# EasyEDA Pro project 3SE_24_Power_Rune.eprj, board 深大PCB参考 (continued)
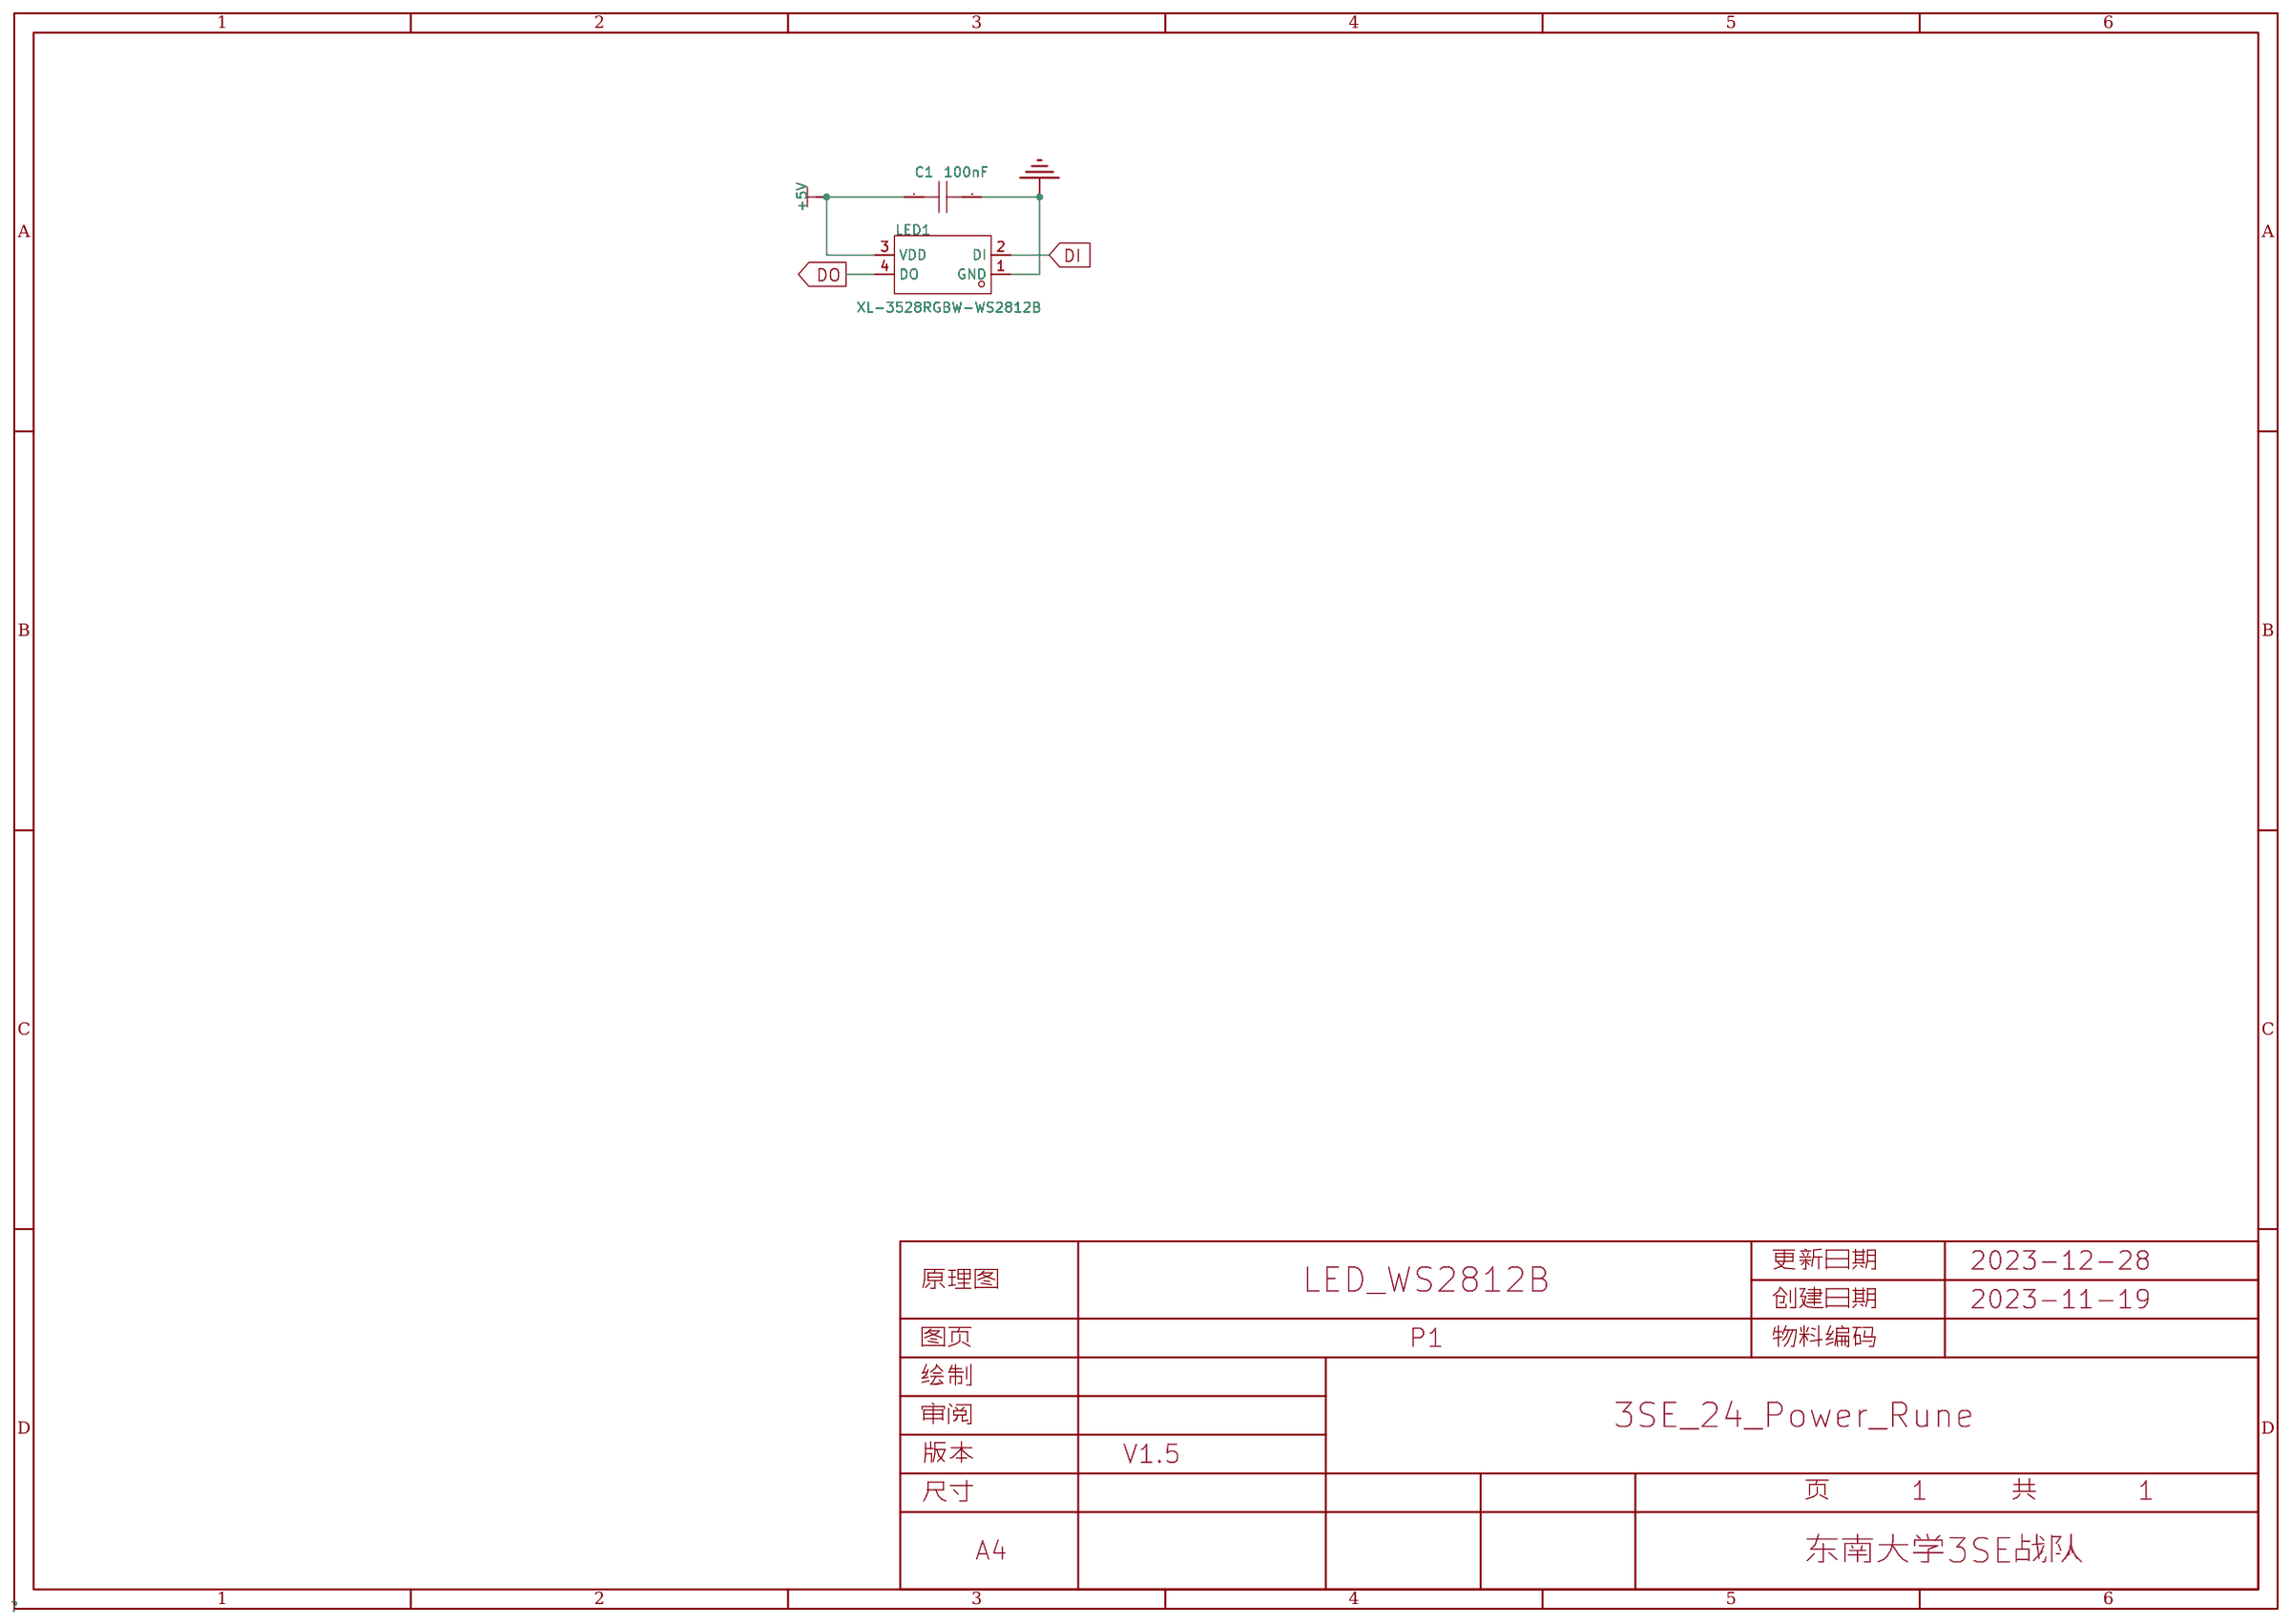
[diagram p0: schematic sheet]
## Placement (name value [footprint] x y rotation side) (continued)
C428  -  [C_0603]  220.09 168.4 54 top
C429  -  [C_0603]  203.58 153.8 105 top
C430  -  [C_0603]  187.32 150.11 6 top
C431  -  [C_0603]  171.7 152.4 342 top
C432  -  [C_0603]  159 158.62 318 top
C433  -  [C_0603]  146.56 172.59 15 top
C434  -  [C_0603]  142.11 193.68 270 top
C435  -  [C_0603]  144.27 206.88 246 top
C436  -  [C_0603]  150.37 217.55 222 top
C437  -  [C_0603]  165.99 229.74 285 top
C438  -  [C_0603]  190.37 234.32 174 top
C439  -  [C_0603]  206.78 228.14 150 top
C440  -  [C_0603]  222.5 212.09 195 top
C441  -  [C_0603]  210.44 203.71 195 top
C442  -  [C_0603]  207.14 177.93 45 top
C443  -  [C_0603]  191.77 178.82 90 top
C444  -  [C_0603]  170.69 169.29 315 top
C445  -  [C_0603]  160.02 182.25 15 top
C446  -  [C_0603]  167.13 198.25 45 top
C447  -  [C_0603]  173.74 218.44 285 top
C448  -  [C_0603]  197.87 217.42 135 top
C449  -  [C_0603]  177.93 205.74 270 top
C450  -  [C_0603]  196.72 188.72 180 top
C451  -  [C_0603]  195.07 166.37 105 top
C452  -  [C_0603]  172.08 195.83 0 top
D1  -  [LED-SMD_4P-L5.0-W5.0-TL_WS2812B-B]  22.35 253.11 160 top
D2  -  [LED-SMD_4P-L5.0-W5.0-TL_WS2812B-B]  33.49 249.33 160 top
D3  -  [LED-SMD_4P-L5.0-W5.0-TL_WS2812B-B]  24.77 265.3 160 top
D4  -  [LED-SMD_4P-L5.0-W5.0-TL_WS2812B-B]  37.46 260.99 160 top
D5  -  [LED-SMD_4P-L5.0-W5.0-TL_WS2812B-B]  27.34 278.74 160 top
D6  -  [LED-SMD_4P-L5.0-W5.0-TL_WS2812B-B]  40.77 273.05 160 top
D7  -  [LED-SMD_4P-L5.0-W5.0-TL_WS2812B-B]  30.1 291.34 160 top
D8  -  [LED-SMD_4P-L5.0-W5.0-TL_WS2812B-B]  44.58 286 160 top
D9  -  [LED-SMD_4P-L5.0-W5.0-TL_WS2812B-B]  33.46 305.61 160 top
D10  -  [LED-SMD_4P-L5.0-W5.0-TL_WS2812B-B]  46.61 300.36 160 top
D11  -  [LED-SMD_4P-L5.0-W5.0-TL_WS2812B-B#3]  37.03 320.47 140 top
D12  -  [LED-SMD_4P-L5.0-W5.0-TL_WS2812B-B#3]  49.02 311.79 140 top
D13  -  [LED-SMD_4P-L5.0-W5.0-TL_WS2812B-B#2]  39.19 342.54 130 top
D14  -  [LED-SMD_4P-L5.0-W5.0-TL_WS2812B-B#2]  45.85 334.52 130 top
D15  -  [LED-SMD_4P-L5.0-W5.0-TL_WS2812B-B#2]  52.2 325.12 130 top
D16  -  [LED-SMD_4P-L5.0-W5.0-TL_WS2812B-B]  56.01 349.5 110 top
D17  -  [LED-SMD_4P-L5.0-W5.0-TL_WS2812B-B]  61.09 338.46 110 top
D18  -  [LED-SMD_4P-L5.0-W5.0-TL_WS2812B-B]  65.41 327.28 110 top
D19  -  [LED-SMD_4P-L5.0-W5.0-TL_WS2812B-B]  68.96 354.33 110 top
D20  -  [LED-SMD_4P-L5.0-W5.0-TL_WS2812B-B]  73.66 342.9 110 top
D21  -  [LED-SMD_4P-L5.0-W5.0-TL_WS2812B-B]  77.34 331.98 110 top
D22  -  [LED-SMD_4P-L5.0-W5.0-TL_WS2812B-B]  81.15 358.78 110 top
D23  -  [LED-SMD_4P-L5.0-W5.0-TL_WS2812B-B]  86.11 347.6 110 top
D24  -  [LED-SMD_4P-L5.0-W5.0-TL_WS2812B-B]  91.82 336.55 110 top
D25  -  [LED-SMD_4P-L5.0-W5.0-TL_WS2812B-B]  96.39 363.35 110 top
D26  -  [LED-SMD_4P-L5.0-W5.0-TL_WS2812B-B]  100.71 350.77 110 top
D27  -  [LED-SMD_4P-L5.0-W5.0-TL_WS2812B-B]  104.52 340.36 110 top
D28  -  [LED-SMD_4P-L5.0-W5.0-TL_WS2812B-B]  110.13 366.99 110 top
D29  -  [LED-SMD_4P-L5.0-W5.0-TL_WS2812B-B]  113.92 354.84 110 top
D30  -  [LED-SMD_4P-L5.0-W5.0-TL_WS2812B-B]  117.98 343.79 110 top
D31  -  [LED-SMD_4P-L5.0-W5.0-TL_WS2812B-B]  120.9 370.71 110 top
D32  -  [LED-SMD_4P-L5.0-W5.0-TL_WS2812B-B]  125.6 359.41 110 top
D33  -  [LED-SMD_4P-L5.0-W5.0-TL_WS2812B-B]  129.79 348.74 110 top
D34  -  [LED-SMD_4P-L5.0-W5.0-TL_WS2812B-B]  132.97 374.14 110 top
D35  -  [LED-SMD_4P-L5.0-W5.0-TL_WS2812B-B]  137.03 362.84 110 top
D36  -  [LED-SMD_4P-L5.0-W5.0-TL_WS2812B-B]  140.59 351.79 110 top
D37  -  [LED-SMD_4P-L5.0-W5.0-TL_WS2812B-B]  150.37 374.78 95 top
D38  -  [LED-SMD_4P-L5.0-W5.0-TL_WS2812B-B]  151.51 364.11 95 top
D39  -  [LED-SMD_4P-L5.0-W5.0-TL_WS2812B-B]  152.65 353.57 95 top
D40  -  [LED-SMD_4P-L5.0-W5.0-TL_WS2812B-B]  166.37 374.65 90 top
D41  -  [LED-SMD_4P-L5.0-W5.0-TL_WS2812B-B]  166.37 364.24 90 top
D42  -  [LED-SMD_4P-L5.0-W5.0-TL_WS2812B-B]  165.99 353.06 90 top
D43  -  [LED-SMD_4P-L5.0-W5.0-TL_WS2812B-B]  179.58 374.78 90 top
D44  -  [LED-SMD_4P-L5.0-W5.0-TL_WS2812B-B]  179.32 363.73 90 top
D45  -  [LED-SMD_4P-L5.0-W5.0-TL_WS2812B-B]  179.07 352.43 90 top
D46  -  [LED-SMD_4P-L5.0-W5.0-TL_WS2812B-B]  193.68 375.03 90 top
D47  -  [LED-SMD_4P-L5.0-W5.0-TL_WS2812B-B]  193.55 363.98 90 top
D48  -  [LED-SMD_4P-L5.0-W5.0-TL_WS2812B-B]  193.55 352.55 90 top
D49  -  [LED-SMD_4P-L5.0-W5.0-TL_WS2812B-B]  206.75 375.2 90 top
D50  -  [LED-SMD_4P-L5.0-W5.0-TL_WS2812B-B]  206.76 364.11 90 top
D51  -  [LED-SMD_4P-L5.0-W5.0-TL_WS2812B-B]  207.26 352.9 90 top
D52  -  [LED-SMD_4P-L5.0-W5.0-TL_WS2812B-B]  220.6 375.2 90 top
D53  -  [LED-SMD_4P-L5.0-W5.0-TL_WS2812B-B]  220.98 365.12 90 top
D54  -  [LED-SMD_4P-L5.0-W5.0-TL_WS2812B-B]  220.47 352.93 90 top
D55  -  [LED-SMD_4P-L5.0-W5.0-TL_WS2812B-B]  239.9 372.62 70 top
D56  -  [LED-SMD_4P-L5.0-W5.0-TL_WS2812B-B]  236.35 361.95 70 top
D57  -  [LED-SMD_4P-L5.0-W5.0-TL_WS2812B-B]  232.18 349.67 70 top
D58  -  [LED-SMD_4P-L5.0-W5.0-TL_WS2812B-B]  254.13 368.55 70 top
D59  -  [LED-SMD_4P-L5.0-W5.0-TL_WS2812B-B]  250.06 357.63 70 top
D60  -  [LED-SMD_4P-L5.0-W5.0-TL_WS2812B-B]  244.98 346.2 70 top
D61  -  [LED-SMD_4P-L5.0-W5.0-TL_WS2812B-B]  267.08 364.36 70 top
D62  -  [LED-SMD_4P-L5.0-W5.0-TL_WS2812B-B]  262.64 353.06 70 top
D63  -  [LED-SMD_4P-L5.0-W5.0-TL_WS2812B-B]  257.68 341.38 70 top
D64  -  [LED-SMD_4P-L5.0-W5.0-TL_WS2812B-B]  281.28 359.75 70 top
D65  -  [LED-SMD_4P-L5.0-W5.0-TL_WS2812B-B]  275.97 348.49 70 top
D66  -  [LED-SMD_4P-L5.0-W5.0-TL_WS2812B-B]  271.02 336.8 70 top
D67  -  [LED-SMD_4P-L5.0-W5.0-TL_WS2812B-B]  293.93 355.42 70 top
D68  -  [LED-SMD_4P-L5.0-W5.0-TL_WS2812B-B]  289.18 344.55 70 top
D69  -  [LED-SMD_4P-L5.0-W5.0-TL_WS2812B-B]  284.07 332.45 70 top
D70  -  [LED-SMD_4P-L5.0-W5.0-TL_WS2812B-B]  306.58 351.03 70 top
D71  -  [LED-SMD_4P-L5.0-W5.0-TL_WS2812B-B]  302.39 340.11 70 top
D72  -  [LED-SMD_4P-L5.0-W5.0-TL_WS2812B-B]  297.94 328.17 70 top
D73  -  [LED-SMD_4P-L5.0-W5.0-TL_WS2812B-B]  318.52 346.84 70 top
D74  -  [LED-SMD_4P-L5.0-W5.0-TL_WS2812B-B]  314.58 336.04 70 top
D75  -  [LED-SMD_4P-L5.0-W5.0-TL_WS2812B-B]  310.77 325.88 70 top
D76  -  [LED-SMD_4P-L5.0-W5.0-TL_WS2812B-B#3]  335.2 337.49 50 top
D77  -  [LED-SMD_4P-L5.0-W5.0-TL_WS2812B-B#3]  326.94 327.71 50 top
D78  -  [LED-SMD_4P-L5.0-W5.0-TL_WS2812B-B#3]  317.67 317.17 50 top
D79  -  [LED-SMD_4P-L5.0-W5.0-TL_WS2812B-B#2]  336.93 316.23 40 top
D80  -  [LED-SMD_4P-L5.0-W5.0-TL_WS2812B-B#2]  323.9 307 40 top
D81  -  [LED-SMD_4P-L5.0-W5.0-TL_WS2812B-B]  340.49 297.43 20 top
D82  -  [LED-SMD_4P-L5.0-W5.0-TL_WS2812B-B]  326.26 292.35 20 top
D83  -  [LED-SMD_4P-L5.0-W5.0-TL_WS2812B-B]  342.19 283.16 20 top
D84  -  [LED-SMD_4P-L5.0-W5.0-TL_WS2812B-B]  329.44 279.53 20 top
D85  -  [LED-SMD_4P-L5.0-W5.0-TL_WS2812B-B]  344.86 268.56 20 top
D86  -  [LED-SMD_4P-L5.0-W5.0-TL_WS2812B-B]  331.6 264.67 20 top
D87  -  [LED-SMD_4P-L5.0-W5.0-TL_WS2812B-B]  347.47 254.25 20 top
D88  -  [LED-SMD_4P-L5.0-W5.0-TL_WS2812B-B]  335.41 249.68 20 top
D89  -  [LED-SMD_4P-L5.0-W5.0-TL_WS2812B-B]  28.83 135.13 20 top
D90  -  [LED-SMD_4P-L5.0-W5.0-TL_WS2812B-B]  12.06 130.18 20 top
D91  -  [LED-SMD_4P-L5.0-W5.0-TL_WS2812B-B]  31.75 123.06 20 top
D92  -  [LED-SMD_4P-L5.0-W5.0-TL_WS2812B-B]  15.58 115.42 20 top
D93  -  [LED-SMD_4P-L5.0-W5.0-TL_WS2812B-B]  34.54 110.1 20 top
D94  -  [LED-SMD_4P-L5.0-W5.0-TL_WS2812B-B]  15.49 102.36 20 top
D95  -  [LED-SMD_4P-L5.0-W5.0-TL_WS2812B-B]  40.08 97.14 20 top
D96  -  [LED-SMD_4P-L5.0-W5.0-TL_WS2812B-B]  26.67 92.84 20 top
D97  -  [LED-SMD_4P-L5.0-W5.0-TL_WS2812B-B]  13.34 87.38 20 top
D98  -  [LED-SMD_4P-L5.0-W5.0-TL_WS2812B-B]  44.32 84.84 30 top
D99  -  [LED-SMD_4P-L5.0-W5.0-TL_WS2812B-B]  30.29 77.98 30 top
D100  -  [LED-SMD_4P-L5.0-W5.0-TL_WS2812B-B]  15.88 70.87 30 top
D101  -  [LED-SMD_4P-L5.0-W5.0-TL_WS2812B-B]  50.16 71.55 30 top
D102  -  [LED-SMD_4P-L5.0-W5.0-TL_WS2812B-B]  38.1 65.41 30 top
D103  -  [LED-SMD_4P-L5.0-W5.0-TL_WS2812B-B]  26.03 58.04 30 top
D104  -  [LED-SMD_4P-L5.0-W5.0-TL_WS2812B-B]  13.59 50.29 30 top
D105  -  [LED-SMD_4P-L5.0-W5.0-TL_WS2812B-B#2]  53.72 58.8 40 top
D106  -  [LED-SMD_4P-L5.0-W5.0-TL_WS2812B-B#2]  42.55 48.7 40 top
D107  -  [LED-SMD_4P-L5.0-W5.0-TL_WS2812B-B#2]  31.37 38.61 40 top
D108  -  [LED-SMD_4P-L5.0-W5.0-TL_WS2812B-B]  65.53 49.78 70 top
D109  -  [LED-SMD_4P-L5.0-W5.0-TL_WS2812B-B]  62.48 40.39 70 top
D110  -  [LED-SMD_4P-L5.0-W5.0-TL_WS2812B-B]  58.42 29.59 70 top
D111  -  [LED-SMD_4P-L5.0-W5.0-TL_WS2812B-B]  78.66 47.57 70 top
D112  -  [LED-SMD_4P-L5.0-W5.0-TL_WS2812B-B]  75.06 36.19 70 top
D113  -  [LED-SMD_4P-L5.0-W5.0-TL_WS2812B-B]  71.5 25.91 70 top
D114  -  [LED-SMD_4P-L5.0-W5.0-TL_WS2812B-B]  92.58 44.07 70 top
D115  -  [LED-SMD_4P-L5.0-W5.0-TL_WS2812B-B]  89.15 31.75 70 top
D116  -  [LED-SMD_4P-L5.0-W5.0-TL_WS2812B-B]  84.96 21.97 70 top
D117  -  [LED-SMD_4P-L5.0-W5.0-TL_WS2812B-B]  108.62 42.11 70 top
D118  -  [LED-SMD_4P-L5.0-W5.0-TL_WS2812B-B]  104.78 29.34 70 top
D119  -  [LED-SMD_4P-L5.0-W5.0-TL_WS2812B-B]  100.46 18.54 70 top
D120  -  [LED-SMD_4P-L5.0-W5.0-TL_WS2812B-B]  124.21 37.08 70 top
D121  -  [LED-SMD_4P-L5.0-W5.0-TL_WS2812B-B]  119.76 25.53 70 top
D122  -  [LED-SMD_4P-L5.0-W5.0-TL_WS2812B-B]  115.44 15.37 70 top
D123  -  [LED-SMD_4P-L5.0-W5.0-TL_WS2812B-B]  136.78 34.29 70 top
D124  -  [LED-SMD_4P-L5.0-W5.0-TL_WS2812B-B]  133.22 22.48 70 top
D125  -  [LED-SMD_4P-L5.0-W5.0-TL_WS2812B-B]  129.41 11.3 70 top
D126  -  [LED-SMD_4P-L5.0-W5.0-TL_WS2812B-B]  149.99 31.37 70 top
D127  -  [LED-SMD_4P-L5.0-W5.0-TL_WS2812B-B]  146.3 20.57 70 top
D128  -  [LED-SMD_4P-L5.0-W5.0-TL_WS2812B-B]  143.38 9.02 70 top
D129  -  [LED-SMD_4P-L5.0-W5.0-TL_WS2812B-B]  160.02 31.88 90 top
D130  -  [LED-SMD_4P-L5.0-W5.0-TL_WS2812B-B]  160.77 20.45 90 top
D131  -  [LED-SMD_4P-L5.0-W5.0-TL_WS2812B-B]  159.55 8.89 90 top
D132  -  [LED-SMD_4P-L5.0-W5.0-TL_WS2812B-B]  174.77 32 90 top
D133  -  [LED-SMD_4P-L5.0-W5.0-TL_WS2812B-B]  174.95 20.45 90 top
D134  -  [LED-SMD_4P-L5.0-W5.0-TL_WS2812B-B]  174.14 8.89 90 top
D135  -  [LED-SMD_4P-L5.0-W5.0-TL_WS2812B-B]  188.54 32 90 top
D136  -  [LED-SMD_4P-L5.0-W5.0-TL_WS2812B-B]  189.13 20.45 90 top
D137  -  [LED-SMD_4P-L5.0-W5.0-TL_WS2812B-B]  188.72 8.89 90 top
D138  -  [LED-SMD_4P-L5.0-W5.0-TL_WS2812B-B]  203.31 32 90 top
D139  -  [LED-SMD_4P-L5.0-W5.0-TL_WS2812B-B]  203.31 20.45 90 top
D140  -  [LED-SMD_4P-L5.0-W5.0-TL_WS2812B-B]  203.31 8.89 90 top
D141  -  [LED-SMD_4P-L5.0-W5.0-TL_WS2812B-B#2]  216.07 33.37 100 top
D142  -  [LED-SMD_4P-L5.0-W5.0-TL_WS2812B-B#2]  218.82 21.45 100 top
D143  -  [LED-SMD_4P-L5.0-W5.0-TL_WS2812B-B#2]  220.85 9.53 100 top
D144  -  [LED-SMD_4P-L5.0-W5.0-TL_WS2812B-B#2]  229.67 35.81 100 top
D145  -  [LED-SMD_4P-L5.0-W5.0-TL_WS2812B-B#2]  232.88 23.75 100 top
D146  -  [LED-SMD_4P-L5.0-W5.0-TL_WS2812B-B#2]  235.71 11.94 100 top
D147  -  [LED-SMD_4P-L5.0-W5.0-TL_WS2812B-B#2]  243.28 38.61 100 top
D148  -  [LED-SMD_4P-L5.0-W5.0-TL_WS2812B-B#2]  246.93 26.29 100 top
D149  -  [LED-SMD_4P-L5.0-W5.0-TL_WS2812B-B#2]  249.75 14.19 100 top
D150  -  [LED-SMD_4P-L5.0-W5.0-TL_WS2812B-B#2]  256.88 40.89 100 top
D151  -  [LED-SMD_4P-L5.0-W5.0-TL_WS2812B-B#2]  259.71 28.83 100 top
D152  -  [LED-SMD_4P-L5.0-W5.0-TL_WS2812B-B#2]  263.4 16.76 100 top
D153  -  [LED-SMD_4P-L5.0-W5.0-TL_WS2812B-B#2]  270.49 43.56 100 top
D154  -  [LED-SMD_4P-L5.0-W5.0-TL_WS2812B-B#2]  275.05 31.62 100 top
D155  -  [LED-SMD_4P-L5.0-W5.0-TL_WS2812B-B#2]  277.62 19.94 100 top
D156  -  [LED-SMD_4P-L5.0-W5.0-TL_WS2812B-B]  283.59 46.23 110 top
D157  -  [LED-SMD_4P-L5.0-W5.0-TL_WS2812B-B]  289.1 34.48 110 top
D158  -  [LED-SMD_4P-L5.0-W5.0-TL_WS2812B-B]  294.89 24.26 110 top
D159  -  [LED-SMD_4P-L5.0-W5.0-TL_WS2812B-B]  298.45 49.15 110 top
D160  -  [LED-SMD_4P-L5.0-W5.0-TL_WS2812B-B]  303.85 38.1 110 top
D161  -  [LED-SMD_4P-L5.0-W5.0-TL_WS2812B-B]  309.25 27.05 110 top
D162  -  [LED-SMD_4P-L5.0-W5.0-TL_WS2812B-B#3]  311.91 53.47 140 top
D163  -  [LED-SMD_4P-L5.0-W5.0-TL_WS2812B-B#3]  322.83 43.66 140 top
D164  -  [LED-SMD_4P-L5.0-W5.0-TL_WS2812B-B#3]  333.88 34.54 140 top
D165  -  [LED-SMD_4P-L5.0-W5.0-TL_WS2812B-B]  318.39 66.06 160 top
D166  -  [LED-SMD_4P-L5.0-W5.0-TL_WS2812B-B]  331.34 59.87 160 top
D167  -  [LED-SMD_4P-L5.0-W5.0-TL_WS2812B-B]  344.04 53.69 160 top
D168  -  [LED-SMD_4P-L5.0-W5.0-TL_WS2812B-B]  356.11 47.5 160 top
D169  -  [LED-SMD_4P-L5.0-W5.0-TL_WS2812B-B]  324.48 80.95 160 top
D170  -  [LED-SMD_4P-L5.0-W5.0-TL_WS2812B-B]  339.22 75.13 160 top
D171  -  [LED-SMD_4P-L5.0-W5.0-TL_WS2812B-B]  353.95 67.89 160 top
D172  -  [LED-SMD_4P-L5.0-W5.0-TL_WS2812B-B]  328.79 95.46 160 top
D173  -  [LED-SMD_4P-L5.0-W5.0-TL_WS2812B-B]  341.94 90.17 160 top
D174  -  [LED-SMD_4P-L5.0-W5.0-TL_WS2812B-B]  355.09 85.75 160 top
D175  -  [LED-SMD_4P-L5.0-W5.0-TL_WS2812B-B]  333.68 109.65 160 top
D176  -  [LED-SMD_4P-L5.0-W5.0-TL_WS2812B-B]  352.68 101.96 160 top
D177  -  [LED-SMD_4P-L5.0-W5.0-TL_WS2812B-B]  338.07 124.48 160 top
D178  -  [LED-SMD_4P-L5.0-W5.0-TL_WS2812B-B]  352.61 119.3 160 top
D179  -  [LED-SMD_4P-L5.0-W5.0-TL_WS2812B-B]  343.03 138.94 160 top
D180  -  [LED-SMD_4P-L5.0-W5.0-TL_WS2812B-B]  354.46 135.38 160 top
D181  -  [LED-SMD_4P-L5.0-W5.0-TL_WS2812B-B]  42.04 192.28 90 top
D182  -  [LED-SMD_4P-L5.0-W5.0-TL_WS2812B-B]  43.11 174.81 7.2 top
D183  -  [LED-SMD_4P-L5.0-W5.0-TL_WS2812B-B]  42.8 153.42 105 top
D184  -  [LED-SMD_4P-L5.0-W5.0-TL_WS2812B-B]  51.89 140.22 111.6 top
D185  -  [LED-SMD_4P-L5.0-W5.0-TL_WS2812B-B]  59.46 124.02 28.8 top
D186  -  [LED-SMD_4P-L5.0-W5.0-TL_WS2812B-B]  69.47 108.46 36 top
D187  -  [LED-SMD_4P-L5.0-W5.0-TL_WS2812B-B#4]  79.88 96.9 43.2 top
D188  -  [LED-SMD_4P-L5.0-W5.0-TL_WS2812B-B]  93.36 82.81 50.4 top
D189  -  [LED-SMD_4P-L5.0-W5.0-TL_WS2812B-B]  107.79 72.26 57.6 top
D190  -  [LED-SMD_4P-L5.0-W5.0-TL_WS2812B-B]  123.44 63.6 64.8 top
D191  -  [LED-SMD_4P-L5.0-W5.0-TL_WS2812B-B#4]  143 57.28 72 top
D192  -  [LED-SMD_4P-L5.0-W5.0-TL_WS2812B-B]  161.42 52.07 79.2 top
D193  -  [LED-SMD_4P-L5.0-W5.0-TL_WS2812B-B]  184.4 49.66 90 top
D194  -  [LED-SMD_4P-L5.0-W5.0-TL_WS2812B-B]  198.25 49.91 93.6 top
D195  -  [LED-SMD_4P-L5.0-W5.0-TL_WS2812B-B]  210.71 52.33 100.8 top
D196  -  [LED-SMD_4P-L5.0-W5.0-TL_WS2812B-B]  223.52 52.2 195 top
D197  -  [LED-SMD_4P-L5.0-W5.0-TL_WS2812B-B]  244.68 63.27 115.2 top
D198  -  [LED-SMD_4P-L5.0-W5.0-TL_WS2812B-B]  260.35 71.88 122.4 top
D199  -  [LED-SMD_4P-L5.0-W5.0-TL_WS2812B-B]  274.87 82.31 129.6 top
D200  -  [LED-SMD_4P-L5.0-W5.0-TL_WS2812B-B#5]  289.94 98.17 136.8 top
D201  -  [LED-SMD_4P-L5.0-W5.0-TL_WS2812B-B]  300.99 110.74 144 top
D202  -  [LED-SMD_4P-L5.0-W5.0-TL_WS2812B-B]  309.37 125.84 151.2 top
D203  -  [LED-SMD_4P-L5.0-W5.0-TL_WS2812B-B]  316.74 139.57 158.4 top
D204  -  [LED-SMD_4P-L5.0-W5.0-TL_WS2812B-B#2]  322.23 156.48 165.6 top
D205  -  [LED-SMD_4P-L5.0-W5.0-TL_WS2812B-B]  325.62 174.03 172.8 top
D206  -  [LED-SMD_4P-L5.0-W5.0-TL_WS2812B-B]  327.02 192.15 180 top
D207  -  [LED-SMD_4P-L5.0-W5.0-TL_WS2812B-B]  325.72 209.72 187.2 top
D208  -  [LED-SMD_4P-L5.0-W5.0-TL_WS2812B-B]  325.37 231.27 285 top
D209  -  [LED-SMD_4P-L5.0-W5.0-TL_WS2812B-B]  316.94 244.31 201.6 top
D210  -  [LED-SMD_4P-L5.0-W5.0-TL_WS2812B-B]  309.38 260.51 208.8 top
D211  -  [LED-SMD_4P-L5.0-W5.0-TL_WS2812B-B]  299.84 275.63 216 top
D212  -  [LED-SMD_4P-L5.0-W5.0-TL_WS2812B-B#4]  291.52 287.43 223.2 top
D213  -  [LED-SMD_4P-L5.0-W5.0-TL_WS2812B-B]  275.48 301.72 230.4 top
D214  -  [LED-SMD_4P-L5.0-W5.0-TL_WS2812B-B]  261.04 312.27 237.6 top
D215  -  [LED-SMD_4P-L5.0-W5.0-TL_WS2812B-B]  245.4 320.93 244.8 top
D216  -  [LED-SMD_4P-L5.0-W5.0-TL_WS2812B-B#4]  228.79 327.55 252 top
D217  -  [LED-SMD_4P-L5.0-W5.0-TL_WS2812B-B]  211.48 332.05 259.2 top
D218  -  [LED-SMD_4P-L5.0-W5.0-TL_WS2812B-B]  198.12 333.88 266.4 top
D219  -  [LED-SMD_4P-L5.0-W5.0-TL_WS2812B-B]  184.4 335.15 270 top
D220  -  [LED-SMD_4P-L5.0-W5.0-TL_WS2812B-B]  162.95 332.71 280.8 top
D221  -  [LED-SMD_4P-L5.0-W5.0-TL_WS2812B-B]  145.16 333.25 15 top
D222  -  [LED-SMD_4P-L5.0-W5.0-TL_WS2812B-B]  123.96 320.79 295.2 top
D223  -  [LED-SMD_4P-L5.0-W5.0-TL_WS2812B-B]  109 313.52 302.4 top
D224  -  [LED-SMD_4P-L5.0-W5.0-TL_WS2812B-B]  94.62 303.15 309.6 top
D225  -  [LED-SMD_4P-L5.0-W5.0-TL_WS2812B-B#5]  78.74 287.53 316.8 top
D226  -  [LED-SMD_4P-L5.0-W5.0-TL_WS2812B-B]  69.98 275.84 324 top
D227  -  [LED-SMD_4P-L5.0-W5.0-TL_WS2812B-B]  60.2 262.89 331.2 top
D228  -  [LED-SMD_4P-L5.0-W5.0-TL_WS2812B-B]  52.2 243.71 338.4 top
D229  -  [LED-SMD_4P-L5.0-W5.0-TL_WS2812B-B#2]  46.61 228.06 345.6 top
D230  -  [LED-SMD_4P-L5.0-W5.0-TL_WS2812B-B]  43.21 210.5 352.8 top
D231  -  [LED-SMD_4P-L5.0-W5.0-TL_WS2812B-B]  57.91 192.28 0 top
D232  -  [LED-SMD_4P-L5.0-W5.0-TL_WS2812B-B]  57.15 175.16 8 top
D233  -  [LED-SMD_4P-L5.0-W5.0-TL_WS2812B-B]  57.28 156.59 105 top
D234  -  [LED-SMD_4P-L5.0-W5.0-TL_WS2812B-B]  66.79 140.74 24 top
D235  -  [LED-SMD_4P-L5.0-W5.0-TL_WS2812B-B]  75.11 124.88 32 top
D236  -  [LED-SMD_4P-L5.0-W5.0-TL_WS2812B-B#2]  85.55 110.32 40 top
D237  -  [LED-SMD_4P-L5.0-W5.0-TL_WS2812B-B]  97.92 97.36 48 top
D238  -  [LED-SMD_4P-L5.0-W5.0-TL_WS2812B-B]  111.97 86.24 56 top
D239  -  [LED-SMD_4P-L5.0-W5.0-TL_WS2812B-B]  127.43 77.19 64 top
D240  -  [LED-SMD_4P-L5.0-W5.0-TL_WS2812B-B#4]  145.67 70.49 72 top
D241  -  [LED-SMD_4P-L5.0-W5.0-TL_WS2812B-B#3]  164.59 65.66 80 top
D242  -  [LED-SMD_4P-L5.0-W5.0-TL_WS2812B-B]  184.28 63.25 90 top
D243  -  [LED-SMD_4P-L5.0-W5.0-TL_WS2812B-B]  197.07 64.48 96 top
D244  -  [LED-SMD_4P-L5.0-W5.0-TL_WS2812B-B]  219.46 66.04 195 top
D245  -  [LED-SMD_4P-L5.0-W5.0-TL_WS2812B-B]  231.8 72.92 112 top
D246  -  [LED-SMD_4P-L5.0-W5.0-TL_WS2812B-B]  248.03 80.77 120 top
D247  -  [LED-SMD_4P-L5.0-W5.0-TL_WS2812B-B]  262.86 90.6 128 top
D248  -  [LED-SMD_4P-L5.0-W5.0-TL_WS2812B-B]  280.42 107.57 136 top
D249  -  [LED-SMD_4P-L5.0-W5.0-TL_WS2812B-B]  287.85 116.16 144 top
D250  -  [LED-SMD_4P-L5.0-W5.0-TL_WS2812B-B]  297.43 131.3 152 top
D251  -  [LED-SMD_4P-L5.0-W5.0-TL_WS2812B-B]  304.82 147.62 160 top
D252  -  [LED-SMD_4P-L5.0-W5.0-TL_WS2812B-B]  309.86 164.81 168 top
D253  -  [LED-SMD_4P-L5.0-W5.0-TL_WS2812B-B]  313.18 191.9 180 top
D254  -  [LED-SMD_4P-L5.0-W5.0-TL_WS2812B-B]  311.28 206.88 184 top
D255  -  [LED-SMD_4P-L5.0-W5.0-TL_WS2812B-B]  311.91 228.47 285 top
D256  -  [LED-SMD_4P-L5.0-W5.0-TL_WS2812B-B]  304.29 238.38 200 top
D257  -  [LED-SMD_4P-L5.0-W5.0-TL_WS2812B-B]  298.16 251.87 208 top
D258  -  [LED-SMD_4P-L5.0-W5.0-TL_WS2812B-B]  288.76 267.12 216 top
D259  -  [LED-SMD_4P-L5.0-W5.0-TL_WS2812B-B]  278.86 278.02 224 top
D260  -  [LED-SMD_4P-L5.0-W5.0-TL_WS2812B-B]  264.08 292.98 232 top
D261  -  [LED-SMD_4P-L5.0-W5.0-TL_WS2812B-B]  249.29 303.08 240 top
D262  -  [LED-SMD_4P-L5.0-W5.0-TL_WS2812B-B]  233.24 311.03 248 top
D263  -  [LED-SMD_4P-L5.0-W5.0-TL_WS2812B-B]  216.23 316.67 256 top
D264  -  [LED-SMD_4P-L5.0-W5.0-TL_WS2812B-B]  198.61 319.89 264 top
D265  -  [LED-SMD_4P-L5.0-W5.0-TL_WS2812B-B]  184.53 321.06 270 top
D266  -  [LED-SMD_4P-L5.0-W5.0-TL_WS2812B-B#2]  163.32 318.9 280 top
D267  -  [LED-SMD_4P-L5.0-W5.0-TL_WS2812B-B]  148.72 318.77 15 top
D268  -  [LED-SMD_4P-L5.0-W5.0-TL_WS2812B-B]  129.16 307.98 296 top
D269  -  [LED-SMD_4P-L5.0-W5.0-TL_WS2812B-B]  113.25 299.16 304 top
D270  -  [LED-SMD_4P-L5.0-W5.0-TL_WS2812B-B]  99.07 288.21 312 top
D271  -  [LED-SMD_4P-L5.0-W5.0-TL_WS2812B-B#3]  86.36 275.72 320 top
D272  -  [LED-SMD_4P-L5.0-W5.0-TL_WS2812B-B]  75.93 260.97 328 top
D273  -  [LED-SMD_4P-L5.0-W5.0-TL_WS2812B-B]  67.42 245.2 336 top
D274  -  [LED-SMD_4P-L5.0-W5.0-TL_WS2812B-B]  61.72 228.35 344 top
D275  -  [LED-SMD_4P-L5.0-W5.0-TL_WS2812B-B]  57.36 210.9 352 top
D276  -  [LED-SMD_4P-L5.0-W5.0-TL_WS2812B-B]  72.39 192.53 0 top
D277  -  [LED-SMD_4P-L5.0-W5.0-TL_WS2812B-B]  72.5 175.9 9 top
D278  -  [LED-SMD_4P-L5.0-W5.0-TL_WS2812B-B]  73.03 158.88 105 top
D279  -  [LED-SMD_4P-L5.0-W5.0-TL_WS2812B-B]  83.11 142.17 27 top
D280  -  [LED-SMD_4P-L5.0-W5.0-TL_WS2812B-B]  92.23 126.97 36 top
D281  -  [LED-SMD_4P-L5.0-W5.0-TL_WS2812B-B]  109.22 108.46 45 top
D282  -  [LED-SMD_4P-L5.0-W5.0-TL_WS2812B-B]  121.41 100.71 54 top
D283  -  [LED-SMD_4P-L5.0-W5.0-TL_WS2812B-B]  132.46 92.84 63 top
D284  -  [LED-SMD_4P-L5.0-W5.0-TL_WS2812B-B#4]  148.35 85.39 72 top
D285  -  [LED-SMD_4P-L5.0-W5.0-TL_WS2812B-B]  165.55 81.09 81 top
D286  -  [LED-SMD_4P-L5.0-W5.0-TL_WS2812B-B]  184.4 79.63 90 top
D287  -  [LED-SMD_4P-L5.0-W5.0-TL_WS2812B-B]  201.39 80.66 99 top
D288  -  [LED-SMD_4P-L5.0-W5.0-TL_WS2812B-B]  218.31 81.28 195 top
D289  -  [LED-SMD_4P-L5.0-W5.0-TL_WS2812B-B]  235.12 91.37 117 top
D290  -  [LED-SMD_4P-L5.0-W5.0-TL_WS2812B-B]  251.59 101.22 126 top
D291  -  [LED-SMD_4P-L5.0-W5.0-TL_WS2812B-B]  268.46 116.78 135 top
D292  -  [LED-SMD_4P-L5.0-W5.0-TL_WS2812B-B]  275.97 126.11 144 top
D293  -  [LED-SMD_4P-L5.0-W5.0-TL_WS2812B-B]  284.48 140.29 153 top
D294  -  [LED-SMD_4P-L5.0-W5.0-TL_WS2812B-B#4]  291.42 156.61 162 top
D295  -  [LED-SMD_4P-L5.0-W5.0-TL_WS2812B-B]  295.72 173.81 171 top
D296  -  [LED-SMD_4P-L5.0-W5.0-TL_WS2812B-B]  297.28 191.47 180 top
D297  -  [LED-SMD_4P-L5.0-W5.0-TL_WS2812B-B]  296.04 209.3 189 top
D298  -  [LED-SMD_4P-L5.0-W5.0-TL_WS2812B-B]  295.91 224.54 285 top
D299  -  [LED-SMD_4P-L5.0-W5.0-TL_WS2812B-B]  285.44 242.89 207 top
D300  -  [LED-SMD_4P-L5.0-W5.0-TL_WS2812B-B]  276.32 258.1 216 top
D301  -  [LED-SMD_4P-L5.0-W5.0-TL_WS2812B-B]  268.25 267.28 225 top
D302  -  [LED-SMD_4P-L5.0-W5.0-TL_WS2812B-B]  251.55 283.33 234 top
D303  -  [LED-SMD_4P-L5.0-W5.0-TL_WS2812B-B]  236.52 292.74 243 top
D304  -  [LED-SMD_4P-L5.0-W5.0-TL_WS2812B-B#4]  220.2 299.68 252 top
D305  -  [LED-SMD_4P-L5.0-W5.0-TL_WS2812B-B]  203.07 304.04 261 top
D306  -  [LED-SMD_4P-L5.0-W5.0-TL_WS2812B-B]  184.66 305.69 270 top
D307  -  [LED-SMD_4P-L5.0-W5.0-TL_WS2812B-B]  167.64 304.31 279 top
D308  -  [LED-SMD_4P-L5.0-W5.0-TL_WS2812B-B]  152.53 304.93 15 top
D309  -  [LED-SMD_4P-L5.0-W5.0-TL_WS2812B-B]  133.92 293.7 297 top
D310  -  [LED-SMD_4P-L5.0-W5.0-TL_WS2812B-B]  118.71 284.57 306 top
D311  -  [LED-SMD_4P-L5.0-W5.0-TL_WS2812B-B]  108.71 276.35 315 top
D312  -  [LED-SMD_4P-L5.0-W5.0-TL_WS2812B-B]  93.48 259.81 324 top
D313  -  [LED-SMD_4P-L5.0-W5.0-TL_WS2812B-B]  84.07 244.78 333 top
D314  -  [LED-SMD_4P-L5.0-W5.0-TL_WS2812B-B#4]  77.13 228.46 342 top
D315  -  [LED-SMD_4P-L5.0-W5.0-TL_WS2812B-B]  72.83 211.25 351 top
D316  -  [LED-SMD_4P-L5.0-W5.0-TL_WS2812B-B]  86.36 192.28 0 top
D317  -  [LED-SMD_4P-L5.0-W5.0-TL_WS2812B-B]  87.98 176.07 10.3 top
D318  -  [LED-SMD_4P-L5.0-W5.0-TL_WS2812B-B]  86.49 162.94 105 top
D319  -  [LED-SMD_4P-L5.0-W5.0-TL_WS2812B-B]  99.84 143.13 30.9 top
D320  -  [LED-SMD_4P-L5.0-W5.0-TL_WS2812B-B]  109.98 128.78 41.1 top
D321  -  [LED-SMD_4P-L5.0-W5.0-TL_WS2812B-B]  122.52 116.46 51.4 top
D322  -  [LED-SMD_4P-L5.0-W5.0-TL_WS2812B-B]  137.06 106.59 61.7 top
D323  -  [LED-SMD_4P-L5.0-W5.0-TL_WS2812B-B]  154 100.12 72 top
D324  -  [LED-SMD_4P-L5.0-W5.0-TL_WS2812B-B]  170.2 95.32 82.3 top
D325  -  [LED-SMD_4P-L5.0-W5.0-TL_WS2812B-B]  184.4 94.36 90 top
D326  -  [LED-SMD_4P-L5.0-W5.0-TL_WS2812B-B]  201.17 95.5 105 top
D327  -  [LED-SMD_4P-L5.0-W5.0-TL_WS2812B-B]  221.04 101.3 113.1 top
D328  -  [LED-SMD_4P-L5.0-W5.0-TL_WS2812B-B]  235.33 108.2 123.4 top
D329  -  [LED-SMD_4P-L5.0-W5.0-TL_WS2812B-B]  248.92 118.24 133.7 top
D330  -  [LED-SMD_4P-L5.0-W5.0-TL_WS2812B-B]  262.61 133.46 144 top
D331  -  [LED-SMD_4P-L5.0-W5.0-TL_WS2812B-B#3]  272.4 148.57 154.3 top
D332  -  [LED-SMD_4P-L5.0-W5.0-TL_WS2812B-B]  279.67 170.48 164.6 top
D333  -  [LED-SMD_4P-L5.0-W5.0-TL_WS2812B-B]  282.45 192.28 180 top
D334  -  [LED-SMD_4P-L5.0-W5.0-TL_WS2812B-B]  281.69 204.98 185.1 top
D335  -  [LED-SMD_4P-L5.0-W5.0-TL_WS2812B-B]  281.56 220.6 285 top
D336  -  [LED-SMD_4P-L5.0-W5.0-TL_WS2812B-B]  273.54 233.62 205.7 top
D337  -  [LED-SMD_4P-L5.0-W5.0-TL_WS2812B-B#4]  264.95 249.53 216 top
D338  -  [LED-SMD_4P-L5.0-W5.0-TL_WS2812B-B]  246.64 267.85 226.3 top
D339  -  [LED-SMD_4P-L5.0-W5.0-TL_WS2812B-B]  233.68 276.48 236.6 top
D340  -  [LED-SMD_4P-L5.0-W5.0-TL_WS2812B-B]  217.81 283.97 246.9 top
D341  -  [LED-SMD_4P-L5.0-W5.0-TL_WS2812B-B]  200.91 288.56 257.1 top
D342  -  [LED-SMD_4P-L5.0-W5.0-TL_WS2812B-B]  184.4 290.07 270 top
D343  -  [LED-SMD_4P-L5.0-W5.0-TL_WS2812B-B]  172.8 289.58 277.7 top
D344  -  [LED-SMD_4P-L5.0-W5.0-TL_WS2812B-B]  155.7 290.32 15 top
D345  -  [LED-SMD_4P-L5.0-W5.0-TL_WS2812B-B]  139.37 279.21 298.3 top
D346  -  [LED-SMD_4P-L5.0-W5.0-TL_WS2812B-B]  124.57 269.73 308.6 top
D347  -  [LED-SMD_4P-L5.0-W5.0-TL_WS2812B-B]  110.37 255.84 318.9 top
D348  -  [LED-SMD_4P-L5.0-W5.0-TL_WS2812B-B]  101.19 243.68 329.1 top
D349  -  [LED-SMD_4P-L5.0-W5.0-TL_WS2812B-B#4]  93.35 227.95 339.4 top
D350  -  [LED-SMD_4P-L5.0-W5.0-TL_WS2812B-B]  88.45 211.07 349.7 top
D351  -  [LED-SMD_4P-L5.0-W5.0-TL_WS2812B-B]  101.09 192.41 0 top
D352  -  [LED-SMD_4P-L5.0-W5.0-TL_WS2812B-B]  100.08 171.58 105 top
D353  -  [LED-SMD_4P-L5.0-W5.0-TL_WS2812B-B]  108.48 158.73 24 top
D354  -  [LED-SMD_4P-L5.0-W5.0-TL_WS2812B-B]  117.23 143.64 36 top
D355  -  [LED-SMD_4P-L5.0-W5.0-TL_WS2812B-B]  131.44 129.29 48 top
D356  -  [LED-SMD_4P-L5.0-W5.0-TL_WS2812B-B]  143.05 120.46 60 top
D357  -  [LED-SMD_4P-L5.0-W5.0-TL_WS2812B-B#4]  157.35 114.94 72 top
D358  -  [LED-SMD_4P-L5.0-W5.0-TL_WS2812B-B]  170.69 111 84 top
D359  -  [LED-SMD_4P-L5.0-W5.0-TL_WS2812B-B]  184.4 108.97 90 top
D360  -  [LED-SMD_4P-L5.0-W5.0-TL_WS2812B-B]  208.66 110.11 195 top
D361  -  [LED-SMD_4P-L5.0-W5.0-TL_WS2812B-B]  226.49 120.59 120 top
D362  -  [LED-SMD_4P-L5.0-W5.0-TL_WS2812B-B]  237.94 128.32 132 top
D363  -  [LED-SMD_4P-L5.0-W5.0-TL_WS2812B-B]  252.24 143.84 144 top
D364  -  [LED-SMD_4P-L5.0-W5.0-TL_WS2812B-B]  260.94 158.96 156 top
D365  -  [LED-SMD_4P-L5.0-W5.0-TL_WS2812B-B]  266.3 175.56 168 top
D366  -  [LED-SMD_4P-L5.0-W5.0-TL_WS2812B-B]  268.1 192.41 180 top
D367  -  [LED-SMD_4P-L5.0-W5.0-TL_WS2812B-B]  269.37 210.06 285 top
D368  -  [LED-SMD_4P-L5.0-W5.0-TL_WS2812B-B]  260.83 225.58 204 top
D369  -  [LED-SMD_4P-L5.0-W5.0-TL_WS2812B-B]  252.09 241.93 216 top
D370  -  [LED-SMD_4P-L5.0-W5.0-TL_WS2812B-B]  235.84 257.94 228 top
D371  -  [LED-SMD_4P-L5.0-W5.0-TL_WS2812B-B]  221.74 265.81 240 top
D372  -  [LED-SMD_4P-L5.0-W5.0-TL_WS2812B-B#4]  202.95 273.56 252 top
D373  -  [LED-SMD_4P-L5.0-W5.0-TL_WS2812B-B]  184.4 275.55 270 top
D374  -  [LED-SMD_4P-L5.0-W5.0-TL_WS2812B-B]  174.88 275.34 276 top
D375  -  [LED-SMD_4P-L5.0-W5.0-TL_WS2812B-B]  159.77 274.45 15 top
D376  -  [LED-SMD_4P-L5.0-W5.0-TL_WS2812B-B]  142.76 264.44 300 top
D377  -  [LED-SMD_4P-L5.0-W5.0-TL_WS2812B-B]  130.18 255.91 312 top
D378  -  [LED-SMD_4P-L5.0-W5.0-TL_WS2812B-B]  117.08 241.73 324 top
D379  -  [LED-SMD_4P-L5.0-W5.0-TL_WS2812B-B]  108.38 226.61 336 top
D380  -  [LED-SMD_4P-L5.0-W5.0-TL_WS2812B-B]  103.02 210.01 348 top
D381  -  [LED-SMD_4P-L5.0-W5.0-TL_WS2812B-B]  116.79 192.4 0 top
D382  -  [LED-SMD_4P-L5.0-W5.0-TL_WS2812B-B]  115.95 170.56 105 top
D383  -  [LED-SMD_4P-L5.0-W5.0-TL_WS2812B-B]  125.09 159.8 28.8 top
D384  -  [LED-SMD_4P-L5.0-W5.0-TL_WS2812B-B#4]  132.46 149.45 43.2 top
D385  -  [LED-SMD_4P-L5.0-W5.0-TL_WS2812B-B]  148.08 135.26 57.6 top
D386  -  [LED-SMD_4P-L5.0-W5.0-TL_WS2812B-B#4]  163.39 127.99 72 top
D387  -  [LED-SMD_4P-L5.0-W5.0-TL_WS2812B-B]  180.04 124.78 86.4 top
D388  -  [LED-SMD_4P-L5.0-W5.0-TL_WS2812B-B]  195.77 125.73 100.8 top
D389  -  [LED-SMD_4P-L5.0-W5.0-TL_WS2812B-B]  213.36 126.87 195 top
D390  -  [LED-SMD_4P-L5.0-W5.0-TL_WS2812B-B]  227.42 140.07 129.6 top
D391  -  [LED-SMD_4P-L5.0-W5.0-TL_WS2812B-B]  239.55 152.55 144 top
D392  -  [LED-SMD_4P-L5.0-W5.0-TL_WS2812B-B]  247.25 167.24 158.4 top
D393  -  [LED-SMD_4P-L5.0-W5.0-TL_WS2812B-B]  251.5 183.66 172.8 top
D394  -  [LED-SMD_4P-L5.0-W5.0-TL_WS2812B-B]  250.76 200.57 187.2 top
D395  -  [LED-SMD_4P-L5.0-W5.0-TL_WS2812B-B]  252.22 214.76 285 top
D396  -  [LED-SMD_4P-L5.0-W5.0-TL_WS2812B-B]  239.21 231.91 216 top
D397  -  [LED-SMD_4P-L5.0-W5.0-TL_WS2812B-B]  224.96 247.34 230.4 top
D398  -  [LED-SMD_4P-L5.0-W5.0-TL_WS2812B-B]  213.33 253.4 244.8 top
D399  -  [LED-SMD_4P-L5.0-W5.0-TL_WS2812B-B]  197.21 259.51 259.2 top
D400  -  [LED-SMD_4P-L5.0-W5.0-TL_WS2812B-B]  184.53 259.59 273.6 top
D401  -  [LED-SMD_4P-L5.0-W5.0-TL_WS2812B-B]  162.94 259.59 15 top
D402  -  [LED-SMD_4P-L5.0-W5.0-TL_WS2812B-B]  148.29 249.44 302.4 top
D403  -  [LED-SMD_4P-L5.0-W5.0-TL_WS2812B-B#5]  133.22 235.33 316.8 top
D404  -  [LED-SMD_4P-L5.0-W5.0-TL_WS2812B-B]  125.22 224.96 331.2 top
D405  -  [LED-SMD_4P-L5.0-W5.0-TL_WS2812B-B#2]  118.95 209.21 345.6 top
D406  -  [LED-SMD_4P-L5.0-W5.0-TL_WS2812B-B]  131.27 192.15 0 top
D407  -  [LED-SMD_4P-L5.0-W5.0-TL_WS2812B-B]  130.94 173.99 105 top
D408  -  [LED-SMD_4P-L5.0-W5.0-TL_WS2812B-B]  141.62 160.81 36 top
D409  -  [LED-SMD_4P-L5.0-W5.0-TL_WS2812B-B]  153.49 149.06 54 top
D410  -  [LED-SMD_4P-L5.0-W5.0-TL_WS2812B-B#4]  168.41 141.55 72 top
D411  -  [LED-SMD_4P-L5.0-W5.0-TL_WS2812B-B]  184.92 139.01 90 top
D412  -  [LED-SMD_4P-L5.0-W5.0-TL_WS2812B-B]  202.56 139.07 195 top
D413  -  [LED-SMD_4P-L5.0-W5.0-TL_WS2812B-B]  216.25 149.36 126 top
D414  -  [LED-SMD_4P-L5.0-W5.0-TL_WS2812B-B]  228.01 161.23 144 top
D415  -  [LED-SMD_4P-L5.0-W5.0-TL_WS2812B-B#4]  235.52 176.15 162 top
D416  -  [LED-SMD_4P-L5.0-W5.0-TL_WS2812B-B]  238.05 192.67 180 top
D417  -  [LED-SMD_4P-L5.0-W5.0-TL_WS2812B-B]  237.74 209.93 285 top
D418  -  [LED-SMD_4P-L5.0-W5.0-TL_WS2812B-B]  227.7 224 216 top
D419  -  [LED-SMD_4P-L5.0-W5.0-TL_WS2812B-B]  216.26 236 234 top
D420  -  [LED-SMD_4P-L5.0-W5.0-TL_WS2812B-B#4]  200.91 243.26 252 top
D421  -  [LED-SMD_4P-L5.0-W5.0-TL_WS2812B-B]  184.4 245.8 270 top
D422  -  [LED-SMD_4P-L5.0-W5.0-TL_WS2812B-B]  166.88 245.36 15 top
D423  -  [LED-SMD_4P-L5.0-W5.0-TL_WS2812B-B]  153.06 235.45 306 top
D424  -  [LED-SMD_4P-L5.0-W5.0-TL_WS2812B-B]  141.7 223.5 324 top
D425  -  [LED-SMD_4P-L5.0-W5.0-TL_WS2812B-B#4]  133.8 208.66 342 top
D426  -  [LED-SMD_4P-L5.0-W5.0-TL_WS2812B-B]  146.51 192.91 0 top
D427  -  [LED-SMD_4P-L5.0-W5.0-TL_WS2812B-B]  146.18 177.04 105 top
D428  -  [LED-SMD_4P-L5.0-W5.0-TL_WS2812B-B]  162.56 161.29 48 top
D429  -  [LED-SMD_4P-L5.0-W5.0-TL_WS2812B-B#4]  173.86 156.21 72 top
D430  -  [LED-SMD_4P-L5.0-W5.0-TL_WS2812B-B]  187.74 154.5 96 top
D431  -  [LED-SMD_4P-L5.0-W5.0-TL_WS2812B-B]  199.14 153.29 195 top
D432  -  [LED-SMD_4P-L5.0-W5.0-TL_WS2812B-B]  216.69 171.73 144 top
D433  -  [LED-SMD_4P-L5.0-W5.0-TL_WS2812B-B]  223.21 183.48 168 top
D434  -  [LED-SMD_4P-L5.0-W5.0-TL_WS2812B-B]  222.12 193.93 195 top
D435  -  [LED-SMD_4P-L5.0-W5.0-TL_WS2812B-B]  222.88 207.65 285 top
D436  -  [LED-SMD_4P-L5.0-W5.0-TL_WS2812B-B]  203.93 224.78 240 top
D437  -  [LED-SMD_4P-L5.0-W5.0-TL_WS2812B-B]  189.02 229.9 264 top
D438  -  [LED-SMD_4P-L5.0-W5.0-TL_WS2812B-B]  170.56 230.25 15 top
D439  -  [LED-SMD_4P-L5.0-W5.0-TL_WS2812B-B]  152.78 213.74 312 top
D440  -  [LED-SMD_4P-L5.0-W5.0-TL_WS2812B-B]  148.08 204.34 336 top
D441  -  [LED-SMD_4P-L5.0-W5.0-TL_WS2812B-B]  159.64 186.69 105 top
D442  -  [LED-SMD_4P-L5.0-W5.0-TL_WS2812B-B]  174.37 171.83 45 top
D443  -  [LED-SMD_4P-L5.0-W5.0-TL_WS2812B-B]  190.37 165.74 195 top
D444  -  [LED-SMD_4P-L5.0-W5.0-TL_WS2812B-B]  204.49 181.67 135 top
D445  -  [LED-SMD_4P-L5.0-W5.0-TL_WS2812B-B]  210.82 199.26 285 top
D446  -  [LED-SMD_4P-L5.0-W5.0-TL_WS2812B-B]  194.2 214.83 225 top
D447  -  [LED-SMD_4P-L5.0-W5.0-TL_WS2812B-B]  178.05 218.82 15 top
D448  -  [LED-SMD_4P-L5.0-W5.0-TL_WS2812B-B]  164.52 201.95 135 top
D449  -  [LED-SMD_4P-L5.0-W5.0-TL_WS2812B-B]  173.68 192.15 0 top
D450  -  [LED-SMD_4P-L5.0-W5.0-TL_WS2812B-B]  186.44 179.07 180 top
D451  -  [LED-SMD_4P-L5.0-W5.0-TL_WS2812B-B]  195.15 192.39 180 top
D452  -  [LED-SMD_4P-L5.0-W5.0-TL_WS2812B-B]  182.25 205.11 0 top
J1  -  [GH1.25-LS-2P]  27.91 235.2 180 bottom
J2  -  [GH1.25-LS-2P]  27.91 153.72 0 bottom
J3  -  [GH1.25-LS-2P]  31.24 192.53 90 bottom
J4  -  [GH1.25-LS-2P]  190.63 198.5 270 bottom
J5  -  [GH1.25-LS-2P]  189.74 214.38 285 bottom
J6  -  [GH1.25-LS-2P]  181.61 227.84 285 bottom
J7  -  [GH1.25-LS-2P]  177.29 241.94 285 bottom
J8  -  [GH1.25-LS-2P]  172.21 251.71 195 bottom
J9  -  [GH1.25-LS-2P]  168.53 266.45 195 bottom
